# EasyEDA Pro project 效果器12-18.eprj, board PCB1
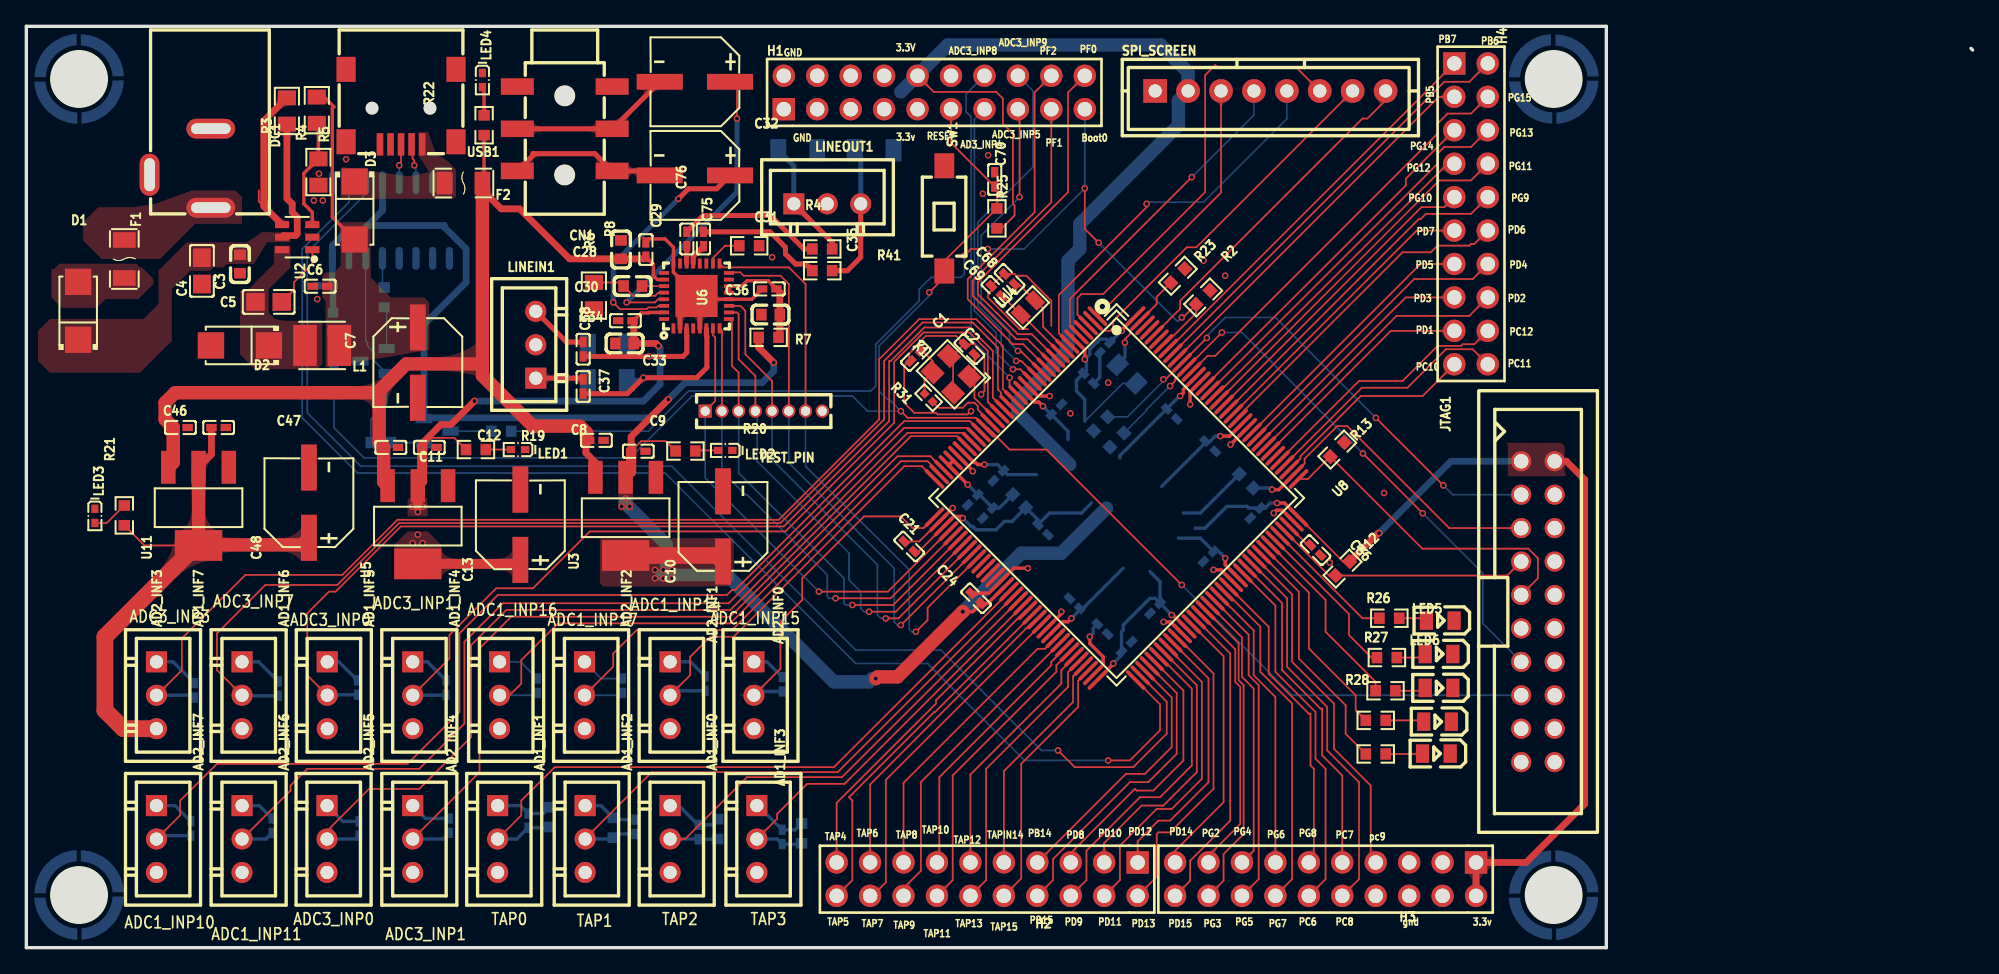
[diagram p8: board, top side]
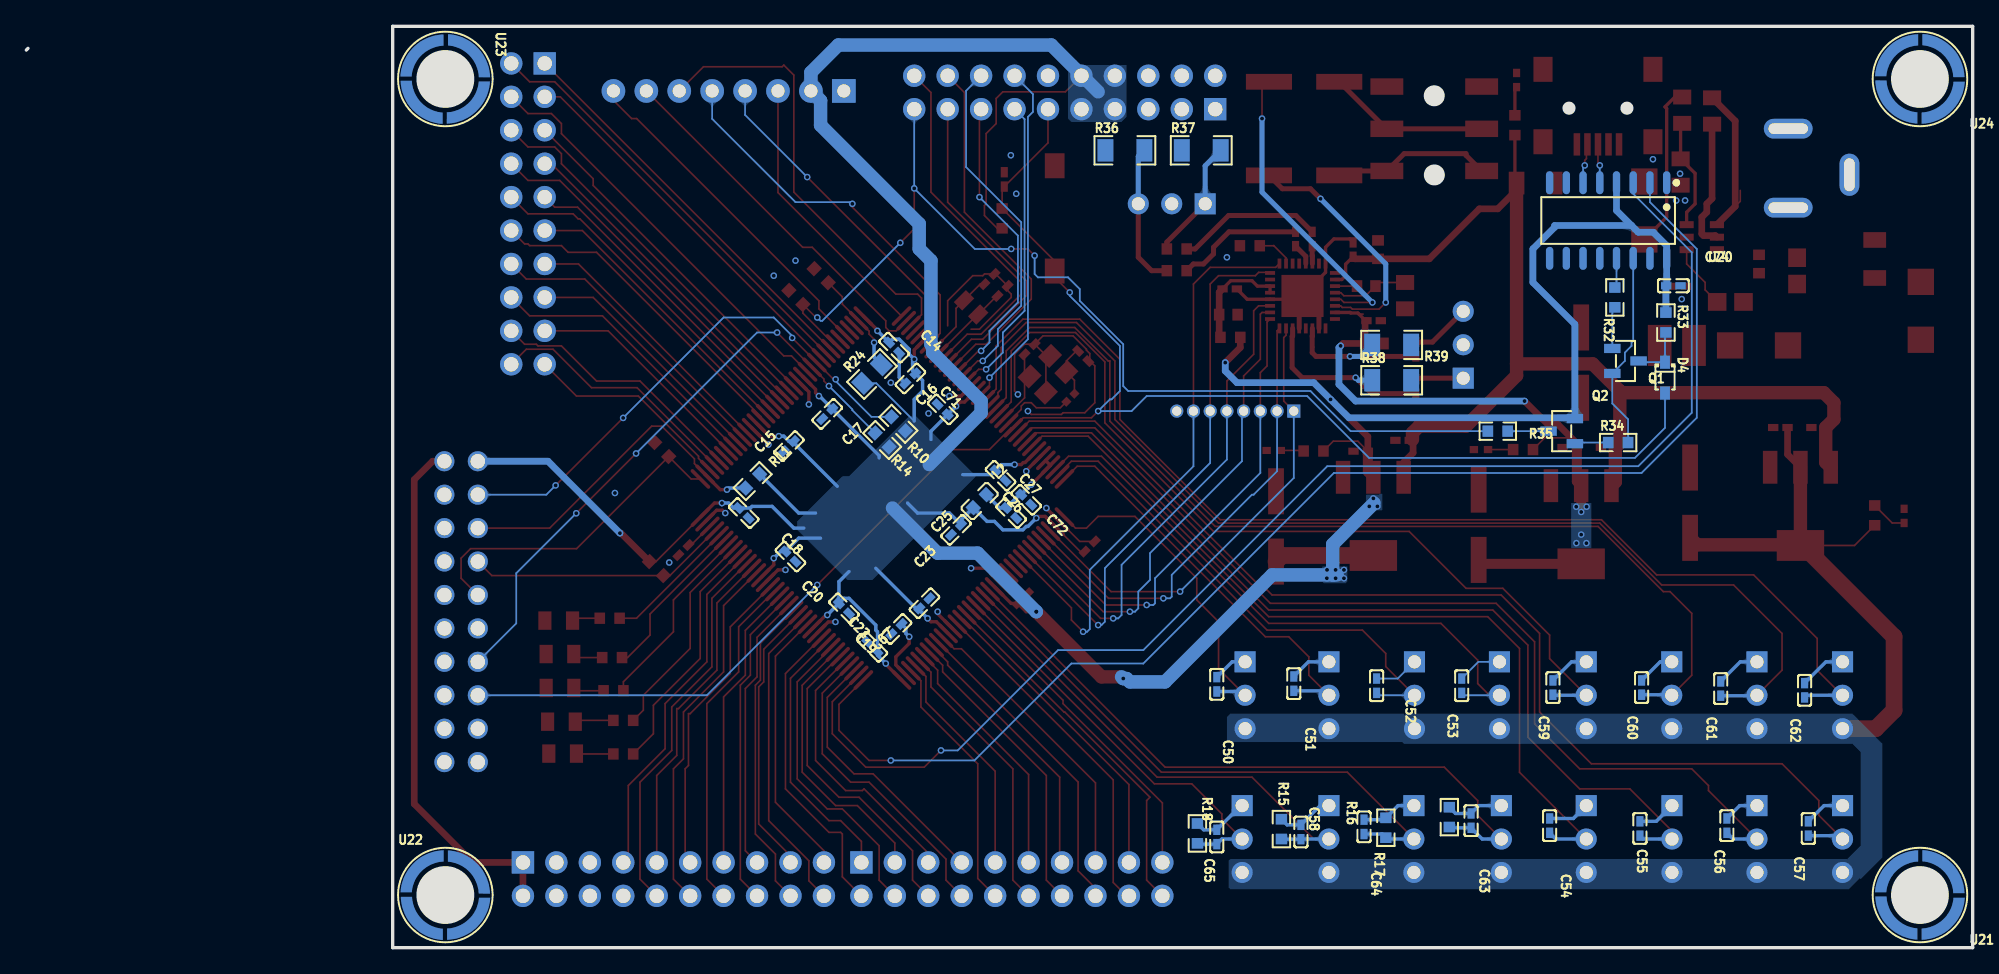
[diagram p9: board, bottom side, seen from below]

Outline 147.83 x 70 mm; copper layers: Top Layer, Bottom Layer. Coordinates in mm from the lower left corner of the outline.
Outline path: 147.83,68.2 147.7,68.33 ; 0,70 120,70 120,0 0,0 0,70
Stack: Top Layer 0.035mm / Dielectric1 1.51mm FR4 er 4.5 / Bottom Layer 0.035mm

## Design rules (mm)
template: JLCPCB Capability(Two Layers Board)
spacing copperThickness1oz (default): track to track 0.102, other pairs 0.152 to 0.3
spacing copperThickness2oz: track to track 0.203, other pairs 0.152 to 0.3
track width copperThickness1oz (default): min 0.127, default 0.254, max 2.54
track width copperThickness2oz: min 0.203, default 0.254, max 2.54
differential pair differentialPair (default): width min 0.127, default 0.254, max 2.54; gap min 0.152, default 0.152
via viaSize (default): diameter min 0.5, default 0.61, max 10; hole min 0.3, default 0.305, max 6.3

## Placement (name value [footprint] x y rotation side)
AD1_INF0  ZX-XH2.54-3PZZ  [CONN-TH_3P-P2.54_2501S-3P]  48.89 8.25 270 top
AD1_INF1  ZX-XH2.54-3PZZ  [CONN-TH_3P-P2.54_2501S-3P]  35.8 8.25 270 top
AD1_INF2  ZX-XH2.54-3PZZ  [CONN-TH_3P-P2.54_2501S-3P]  42.44 8.25 270 top
AD1_INF3  ZX-XH2.54-3PZZ  [CONN-TH_3P-P2.54_2501S-3P]  55.48 8.25 270 top
AD1_INF4  ZX-XH2.54-3PZZ  [CONN-TH_3P-P2.54_2501S-3P]  29.35 19.18 270 top
AD1_INF5  ZX-XH2.54-3PZZ  [CONN-TH_3P-P2.54_2501S-3P]  22.86 19.18 270 top
AD1_INF6  ZX-XH2.54-3PZZ  [CONN-TH_3P-P2.54_2501S-3P]  16.38 19.18 270 top
AD1_INF7  ZX-XH2.54-3PZZ  [CONN-TH_3P-P2.54_2501S-3P]  9.88 19.18 270 top
AD2_INF0  ZX-XH2.54-3PZZ  [CONN-TH_3P-P2.54_2501S-3P]  55.26 19.18 270 top
AD2_INF1  ZX-XH2.54-3PZZ  [CONN-TH_3P-P2.54_2501S-3P]  48.89 19.18 270 top
AD2_INF2  ZX-XH2.54-3PZZ  [CONN-TH_3P-P2.54_2501S-3P]  42.39 19.18 270 top
AD2_INF3  ZX-XH2.54-3PZZ  [CONN-TH_3P-P2.54_2501S-3P]  35.94 19.18 270 top
AD2_INF4  ZX-XH2.54-3PZZ  [CONN-TH_3P-P2.54_2501S-3P]  29.35 8.25 270 top
AD2_INF5  ZX-XH2.54-3PZZ  [CONN-TH_3P-P2.54_2501S-3P]  22.84 8.25 270 top
AD2_INF6  ZX-XH2.54-3PZZ  [CONN-TH_3P-P2.54_2501S-3P]  16.38 8.25 270 top
AD2_INF7  ZX-XH2.54-3PZZ  [CONN-TH_3P-P2.54_2501S-3P]  9.88 8.25 270 top
C1  10pF  [C0402]  67.55 44.95 225 top
C2  10pF  [C0402]  71.63 45.47 135 top
C3  100nF  [C0603]  16.23 51.94 90 top
C4  10uF  [C0805]  13.33 51.42 90 top
C5  10nF  [C0805]  18.41 49.06 0 top
C6  100nF  [C0402]  22.31 50.25 0 top
C7  100uF  [CAP-SMD_BD6.3-L6.6-W6.6-FD]  29.73 44.45 270 top
C8  100nF  [C0402]  43.3 38.55 180 top
C9  100nF  [C0402]  46.48 37.72 180 top
C10  100uF  [CAP-SMD_BD6.3-L6.6-W6.6-FD]  52.91 32 90 top
C11  100nF  [C0402]  27.69 38 180 top
C12  100nF  [C0402]  30.61 38 180 top
C13  100uF  [CAP-SMD_BD6.3-L6.6-W6.6-FD]  37.52 32.13 90 top
C14  100nF  [C0402]  81.91 45.59 45 bottom
C15  100nF  [C0402]  89.92 38.1 135 bottom
C16  100nF  [C0402]  80.68 43.25 135 bottom
C17  100nF  [C0402]  87 40.55 135 bottom
C18  100nF  [C0402]  93.34 33.02 45 bottom
C19  100nF  [C0402]  85.72 25.78 45 bottom
C20  100nF  [C0402]  89.79 29.72 45 bottom
C21  100nF  [C0402]  67.06 30.48 315 top
C22  100nF  [C0402]  83.57 22.86 225 bottom
C23  100nF  [C0402]  79.61 26.16 315 bottom
C24  100nF  [C0402]  72.14 26.54 315 top
C25  100nF  [C0402]  77.22 31.75 135 bottom
C26  100nF  [C0402]  73.03 33.02 45 bottom
C27  100nF  [C0402]  71.88 34.04 45 bottom
C28  10uF  [C0603]  45.16 53.03 270 top
C29  100nF  [C0402]  47.06 53.04 270 top
C30  10uF  [C0603]  46.06 50.26 0 top
C31  100uF  [CAP-SMD_BD6.3-L6.6-W6.6-FD]  50.78 58.67 180 top
C32  100uF  [CAP-SMD_BD6.3-L6.6-W6.6-FD]  50.78 65.79 180 top
C33  10uF  [C0603]  45.44 45.9 0 top
C34  100nF  [C0402]  45.5 47.64 0 top
C35  10uF  [C0603]  56.53 48.1 0 top
C36  100nF  [C0402]  56.43 50.05 0 top
C37  1uF  [C0402]  42.29 42.64 90 top
C38  1uF  [C0402]  42.29 45.47 90 top
C46  100nF  [C0402]  11.7 39.52 180 top
C47  100nF  [C0402]  14.61 39.52 180 top
C48  100uF  [CAP-SMD_BD6.3-L6.6-W6.6-FD]  21.46 33.81 90 top
C50  2.2uF  [C0402]  57.41 20.01 90 bottom
C51  2.2uF  [C0402]  51.56 20.06 90 bottom
C52  2.2uF  [C0402]  45.27 19.9 90 bottom
C53  2.2uF  [C0402]  38.81 19.9 90 bottom
C54  2.2uF  [C0402]  32.13 9.27 90 bottom
C55  2.2uF  [C0402]  25.27 9.06 90 bottom
C56  2.2uF  [C0402]  18.67 9.27 90 bottom
C57  2.2uF  [C0402]  12.48 9.06 90 bottom
C58  2.2uF  [C0402]  51.02 8.79 90 bottom
C59  2.2uF  [C0402]  31.88 19.76 90 bottom
C60  2.2uF  [C0402]  25.15 19.76 90 bottom
C61  2.2uF  [C0402]  19.14 19.69 90 bottom
C62  2.2uF  [C0402]  12.77 19.55 90 bottom
C63  2.2uF  [C0402]  38.1 9.65 90 bottom
C64  2.2uF  [C0402]  46.23 9.18 90 bottom
C65  2.2uF  [C0402]  57.41 8.41 90 bottom
C66  2.2uF  [C0402]  97.92 30.21 135 top
C67  2.2uF  [C0402]  81.74 24.21 315 bottom
C68  20pF  [C0402]  74.68 50.8 315 top
C69  20pF  [C0402]  73.68 49.9 315 top
C70  100nF  [C0402]  73.55 58.37 270 top
C71  100nF  [C0402]  78.23 40.89 225 bottom
C72  100nF  [C0402]  73.84 35.86 45 bottom
C74  100nF  [C0402]  22.73 50.29 0 bottom
C75  1uF  [C0402]  51.43 53.84 270 top
C76  1uF  [C0402]  50.17 53.84 270 top
CN1  PJ-313D  [AUDIO-SMD_PJ-313D-2]  40.89 62.22 0 top
D1  SS24  [SMA_L4.3-W2.6-LS5.2-RD]  3.94 48.39 90 top
D2  SS24  [SMA_L4.3-W2.6-LS5.2-RD]  16.22 45.76 180 top
D3  SS24  [SMA_L4.3-W2.6-LS5.2-RD]  24.94 56.01 270 top
D4  1N4148WS  [SOD-323_L1.8-W1.3-LS2.5-RD]  23.37 43.31 270 bottom
DC1  DC-005-A250  [DC-IN-TH_DC-005-A250]  11.68 59.22 270 top
F1  BSMD1206-100-16V  [F1206]  7.44 52.32 270 top
F2  BSMD1206-100-16V  [F1206]  33.2 58.09 180 top
H1  PZ254V-12-20P  [HDR-TH_20P-P2.54-V-M-R2-C10-S2.54]  68.96 64.97 0 top
H2  PZ254V-12-20P  [HDR-TH_20P-P2.54-V-M-R2-C10-S2.54]  72.97 5.21 180 top
H3  PZ254V-12-20P  [HDR-TH_20P-P2.54-V-M-R2-C10-S2.54]  98.68 5.21 180 top
H4  PZ254V-12-20P  [HDR-TH_20P-P2.54-V-M-R2-C10-S2.54]  109.73 55.75 270 top
JTAG1  BH254V-20P  [CONN-TH_20P-P2.54_0702462001]  114.81 25.53 270 top
L1  4.7uH  [IND-SMD_L3.5-W3.0]  22.47 45.76 180 top
L2  PZ1608D121-2R0TF  [L0603]  75.41 33.93 135 bottom
LED1  TJ-S1005SW4TGLC9Y-A5  [LED0402-RD_YELLOW]  37.35 37.84 180 top
LED2  TJ-S1005SW4TGLC9Y-A5  [LED0402-RD_YELLOW]  53.09 37.78 180 top
LED3  TJ-S1005SW4TGLC9Y-A5  [LED0402-RD_YELLOW]  5.21 32.8 270 top
LED4  TJ-S1005SW4TGLC9Y-A5  [LED0402-RD_YELLOW]  34.64 65.92 270 top
LED5  NCD0805R1  [LED0805-R-RD]  107.39 24.85 180 top
LED6  NCD0805R1  [LED0805-R-RD]  107.3 22.31 180 top
LED7  NCD0805R1  [LED0805-R-RD]  107.29 19.73 180 top
LED8  NCD0805R1  [LED0805-R-RD]  107.18 17.17 180 top
LED9  NCD0805R1  [LED0805-R-RD]  107.09 14.75 180 top
LINEIN1  ZX-XH2.54-3PZZ  [CONN-TH_3P-P2.54_2501S-3P]  38.69 45.81 90 top
LINEOUT1  ZX-XH2.54-3PZZ  [CONN-TH_3P-P2.54_2501S-3P]  60.83 56.52 0 top
Q1  S8050  [SOT-23-3_L2.9-W1.3-P1.90-LS2.4-BR]  26.37 44.58 0 bottom
Q2  S8550  [SOT-23-3_L2.9-W1.3-P1.90-LS2.4-BR]  31.21 39.24 180 bottom
R2  10kΩ  [R0603]  89.38 49.4 225 top
R3  12.1kΩ  [R0805]  19.79 63.57 90 top
R4  68kΩ  [R0805]  22.06 63.63 270 top
R5  12.1kΩ  [R0805]  22.18 58.93 90 top
R6  0Ω  [R0805]  43.11 49.54 270 top
R7  10Ω  [R0603]  56.38 46.37 0 top
R8  10kΩ  [R0603]  54.9 53.33 180 top
R10  10kΩ  [R0603]  81.59 39.8 225 bottom
R11  10kΩ  [R0603]  92.66 35.45 135 bottom
R12  10kΩ  [R0603]  99.97 28.8 45 top
R13  10kΩ  [R0603]  99.57 37.85 45 top
R14  10kΩ  [R0603]  82.83 38.57 225 bottom
R15  4.7kΩ  [R0603]  52.5 9.01 270 bottom
R16  4.7kΩ  [R0603]  39.75 9.92 270 bottom
R17  4.7kΩ  [R0603]  44.57 9.11 270 bottom
R18  4.7kΩ  [R0603]  58.88 8.68 270 bottom
R19  4.7kΩ  [R0603]  34.15 37.84 180 top
R20  4.7kΩ  [R0603]  50.06 37.73 180 top
R21  4.7kΩ  [R0603]  7.44 32.84 270 top
R22  4.7kΩ  [R0603]  34.77 62.49 270 top
R23  10kΩ  [R0603]  87.46 51.05 45 top
R24  0Ω  [R0805]  83.59 43.58 135 bottom
R25  10kΩ  [R0603]  73.71 55.41 270 top
R26  1kΩ  [R0603]  103.52 25.03 0 top
R27  1kΩ  [R0603]  103.34 22.04 0 top
R28  1kΩ  [R0603]  103.23 19.52 0 top
R29  1kΩ  [R0603]  102.49 17.27 0 top
R30  1kΩ  [R0603]  102.49 14.72 0 top
R31  30Ω  [R0402]  68.53 41.78 315 top
R32  1kΩ  [R0603]  27.18 49.4 90 bottom
R33  10kΩ  [R0603]  23.3 47.5 270 bottom
R34  1kΩ  [R0603]  26.92 38.38 180 bottom
R35  1kΩ  [R0603]  36.07 39.24 0 bottom
R36  1MΩ  [R1206]  64.39 60.58 180 bottom
R37  1MΩ  [R1206]  58.59 60.58 180 bottom
R38  1MΩ  [R1206]  44.13 43.11 180 bottom
R39  1MΩ  [R1206]  44.13 45.8 0 bottom
R41  100Ω  [R0603]  60.45 51.44 180 top
R42  100Ω  [R0603]  60.45 53.09 0 top
SPI_SCREEN  XH-8A  [CONN-TH_8P-P2.50_HCTL_XH-8A_C2908606]  94.49 65.09 0 top
SW1  TS-1101-C-W  [SW-SMD_L6.0-W3.3-LS8.0]  69.72 55.41 270 top
TEST_PIN  PZ127V-11-08-H25  [HDR-TH_8P-P1.27_PZ127V-11-08-H25]  56.01 40.77 0 top
U2  TPMP2359DJ  [SOT-23-6_L2.9-W1.6-P0.95-LS2.8-BL]  20.57 53.98 90 top
U3  LM1117S-3.3  [SOT-223-3_L6.5-W3.4-P2.30-LS7.0-BR]  45.52 32.77 90 top
U5  LM1117S-3.3  [SOT-223-3_L6.5-W3.4-P2.30-LS7.0-BR]  29.73 32.13 90 top
U6  WM8978CGEFL/RV  [WQFN-32_L5.0-W5.0-P0.50-TL-EP]  50.9 49.51 90 top
U8  STM32H743ZIT6  [LQFP-144_L20.0-W20.0-P0.50-LS22.0-BL]  82.8 34.16 225 top
U11  LM1117S-3.3  [SOT-223-3_L6.5-W3.4-P2.30-LS7.0-BR]  13.08 33.53 90 top
U14  32.768kHz  [CRYSTAL-SMD_L2.0-W1.2]  76.07 48.65 225 top
U20  CH340C  [SOP-16_L10.0-W3.9-P1.27-LS6.0-BL]  27.69 55.25 0 bottom
U21  SMTSO3050CTJ  [SMD_SMTSO3060CTJ]  4.01 4 0 bottom
U22  SMTSO3050CTJ  [SMD_SMTSO3060CTJ]  116 4 180 bottom
U23  SMTSO3050CTJ  [SMD_SMTSO3060CTJ]  116 66 270 bottom
U24  SMTSO3050CTJ  [SMD_SMTSO3060CTJ]  4.01 66 0 bottom
USB1  UX-144S-ACP5  [MINI-USB-SMD_UX-144S-ACP5]  28.46 63.88 180 top
X1  24MHz  [OSC-SMD_4P-L3.2-W2.5-BL]  70.23 43.56 135 top

## Footprints (pads in the part's own frame, mm; a bottom-side part is the same pattern mirrored in y, then rotated)
AUDIO-SMD_PJ-313D-2
  rect 2.5x1.25 smd: 1(-3.6,3.205) 1(3.6,3.205) 2(-3.6,-0.005) 2(3.6,-0.005) 3(-3.6,-3.205) 3(3.6,-3.205)
C0402
  rect 0.79x0.54 smd: 1(-0.545,0) 2(0.545,0)
C0603
  rect 0.8x0.9 smd: 1(-0.7,0) 2(0.7,0)
C0805
  rect 1.41x1.35 smd: 1(-1,0) 2(1,0)
CAP-SMD_BD6.3-L6.6-W6.6-FD
  rect 3.5x1.2 smd: 1(-2.67,0) 2(2.67,0)
CONN-TH_3P-P2.54_2501S-3P
  rect 1.6x1.6 hole 1: 1(-2.54,0)
  round 1.6 hole 1: 2(0,0) 3(2.54,0)
CONN-TH_8P-P2.50_HCTL_XH-8A_C2908606
  rect 1.8x1.8 hole 1: 1(-8.75,0.001)
  round 1.8 hole 1: 2(-6.25,0.001) 3(-3.749,0.001) 4(-1.25,0) 5(1.25,0) 6(3.75,-0.001) 7(6.25,-0.001) 8(8.75,-0.001)
CONN-TH_20P-P2.54_0702462001
  round 1.524 hole 1.1: 1(-11.43,-1.27) 2(-11.43,1.27) 3(-8.89,-1.27) 4(-8.89,1.27) 5(-6.35,-1.27) 6(-6.35,1.27) 7(-3.81,-1.27) 8(-3.81,1.27) 9(-1.27,-1.27) 10(-1.27,1.27) 11(1.27,-1.27) 12(1.27,1.27) 13(3.81,-1.27) 14(3.81,1.27) 15(6.35,-1.27) 16(6.35,1.27) 17(8.89,-1.27) 18(8.89,1.27) 19(11.43,-1.27) 20(11.43,1.27)
CRYSTAL-SMD_L2.0-W1.2
  rect 0.9x1.3 smd: 1(-0.762,0) 2(0.762,0)
DC-IN-TH_DC-005-A250
  oval 1.5x3.7 hole 0.8x3: 1(3,2.325) 2(-3,2.325)
  oval 3.2x1.5 hole 2.5x0.8: 3(0.5,-2.325)
F1206
  rect 1.19x1.728 smd: 1(-1.445,0) 2(1.445,0)
HDR-TH_8P-P1.27_PZ127V-11-08-H25
  rect 1x1 hole 0.7: 1(-4.445,0)
  round 1 hole 0.7: 2(-3.175,0) 3(-1.905,0) 4(-0.635,0) 5(0.635,0) 6(1.905,0) 7(3.175,0) 8(4.445,0)
HDR-TH_20P-P2.54-V-M-R2-C10-S2.54
  rect 1.7x1.7 hole 1.1: 1(-11.43,-1.27)
  round 1.7 hole 1.1: 2(-11.43,1.27) 3(-8.89,-1.27) 4(-8.89,1.27) 5(-6.35,-1.27) 6(-6.35,1.27) 7(-3.81,-1.27) 8(-3.81,1.27) 9(-1.27,-1.27) 10(-1.27,1.27) 11(1.27,-1.27) 12(1.27,1.27) 13(3.81,-1.27) 14(3.81,1.27) 15(6.35,-1.27) 16(6.35,1.27) 17(8.89,-1.27) 18(8.89,1.27) 19(11.43,-1.27) 20(11.43,1.27)
IND-SMD_L3.5-W3.0
  rect 1.8x3.12 smd: 1(1.303,0) 2(-1.303,0)
L0603
  rect 0.8x0.864 smd: 1(-0.7,0) 2(0.7,0)
LED0402-RD_YELLOW
  rect 0.636x0.54 smd: 1(-0.538,0) 2(0.538,0)
LED0805-R-RD
  rect 1x1.399 smd: 1(1.05,0) 2(-1.05,0)
LQFP-144_L20.0-W20.0-P0.50-LS22.0-BL
  oval 0.28x2 smd: 1(-8.75,-10.8) 2(-8.25,-10.8) 3(-7.75,-10.8) 4(-7.25,-10.8) 5(-6.75,-10.8) 6(-6.25,-10.8) 7(-5.75,-10.8) 8(-5.25,-10.8) 9(-4.75,-10.8) 10(-4.25,-10.8) 11(-3.75,-10.8) 12(-3.25,-10.8) 13(-2.75,-10.8) 14(-2.25,-10.8) 15(-1.75,-10.8) 16(-1.25,-10.8) 17(-0.75,-10.8) 18(-0.25,-10.8) 19(0.25,-10.8) 20(0.75,-10.8) 21(1.25,-10.8) 22(1.75,-10.8) 23(2.25,-10.8) 24(2.75,-10.8) 25(3.25,-10.8) 26(3.75,-10.8) 27(4.25,-10.8) 28(4.75,-10.8) 29(5.25,-10.8) 30(5.75,-10.8) 31(6.25,-10.8) 32(6.75,-10.8) 33(7.25,-10.8) 34(7.75,-10.8) 35(8.25,-10.8) 36(8.75,-10.8) 73(8.75,10.8) 74(8.25,10.8) 75(7.75,10.8) 76(7.25,10.8) 77(6.75,10.8) 78(6.25,10.8) 79(5.75,10.8) 80(5.25,10.8) 81(4.75,10.8) 82(4.25,10.8) 83(3.75,10.8) 84(3.25,10.8) 85(2.75,10.8) 86(2.25,10.8) 87(1.75,10.8) 88(1.25,10.8) 89(0.75,10.8) 90(0.25,10.8) 91(-0.25,10.8) 92(-0.75,10.8) 93(-1.25,10.8) 94(-1.75,10.8) 95(-2.25,10.8) 96(-2.75,10.8) 97(-3.25,10.8) 98(-3.75,10.8) 99(-4.25,10.8) 100(-4.75,10.8) 101(-5.25,10.8) 102(-5.75,10.8) 103(-6.25,10.8) 104(-6.75,10.8) 105(-7.25,10.8) 106(-7.75,10.8) 107(-8.25,10.8) 108(-8.75,10.8)
  oval 2x0.28 smd: 37(10.8,-8.75) 38(10.8,-8.25) 39(10.8,-7.75) 40(10.8,-7.25) 41(10.8,-6.75) 42(10.8,-6.25) 43(10.8,-5.75) 44(10.8,-5.25) 45(10.8,-4.75) 46(10.8,-4.25) 47(10.8,-3.75) 48(10.8,-3.25) 49(10.8,-2.75) 50(10.8,-2.25) 51(10.8,-1.75) 52(10.8,-1.25) 53(10.8,-0.75) 54(10.8,-0.25) 55(10.8,0.25) 56(10.8,0.75) 57(10.8,1.25) 58(10.8,1.75) 59(10.8,2.25) 60(10.8,2.75) 61(10.8,3.25) 62(10.8,3.75) 63(10.8,4.25) 64(10.8,4.75) 65(10.8,5.25) 66(10.8,5.75) 67(10.8,6.25) 68(10.8,6.75) 69(10.8,7.25) 70(10.8,7.75) 71(10.8,8.25) 72(10.8,8.75) 109(-10.8,8.75) 110(-10.8,8.25) 111(-10.8,7.75) 112(-10.8,7.25) 113(-10.8,6.75) 114(-10.8,6.25) 115(-10.8,5.75) 116(-10.8,5.25) 117(-10.8,4.75) 118(-10.8,4.25) 119(-10.8,3.75) 120(-10.8,3.25) 121(-10.8,2.75) 122(-10.8,2.25) 123(-10.8,1.75) 124(-10.8,1.25) 125(-10.8,0.75) 126(-10.8,0.25) 127(-10.8,-0.25) 128(-10.8,-0.75) 129(-10.8,-1.25) 130(-10.8,-1.75) 131(-10.8,-2.25) 132(-10.8,-2.75) 133(-10.8,-3.25) 134(-10.8,-3.75) 135(-10.8,-4.25) 136(-10.8,-4.75) 137(-10.8,-5.25) 138(-10.8,-5.75) 139(-10.8,-6.25) 140(-10.8,-6.75) 141(-10.8,-7.25) 142(-10.8,-7.75) 143(-10.8,-8.25) 144(-10.8,-8.75)
MINI-USB-SMD_UX-144S-ACP5
  rect 0.5x1.7 smd: 1(-1.6,2.85) 2(-0.8,2.85) 3(0,2.85) 4(0.8,2.85) 5(1.6,2.85)
  rect 1.45x1.9 smd: 6(-4.175,2.65) 7(-4.175,-2.85) 8(4.175,-2.85) 9(4.175,2.65)
OSC-SMD_4P-L3.2-W2.5-BL
  rect 1.4x1.2 smd: 1(-1.1,-0.875) 2(1.1,-0.875) 3(1.1,0.875) 4(-1.1,0.875)
R0402
  rect 0.566x0.54 smd: 1(-0.433,0) 2(0.433,0)
R0603
  rect 0.806x0.864 smd: 1(-0.753,0) 2(0.753,0)
R0805
  rect 1.133x1.377 smd: 1(-1,0) 2(1,0)
R1206
  rect 1.208x1.701 smd: 1(-1.479,0) 2(1.479,0)
SMA_L4.3-W2.6-LS5.2-RD
  rect 2x2 smd: 1(-2.2,0) 2(2.2,0)
SMD_SMTSO3060CTJ
  custom 3.197x3.278 smd: 1(1.79,2.34)
  custom 3.279x3.197 smd: 2(1.768,-2.386) 4(-1.769,2.386)
  custom 3.197x3.279 smd: 3(-1.79,-2.369)
SOD-323_L1.8-W1.3-LS2.5-RD
  rect 1x0.75 smd: 1(-1.173,0) 2(1.173,0)
SOP-16_L10.0-W3.9-P1.27-LS6.0-BL
  oval 0.56x1.745 smd: 1(-4.445,-2.873) 2(-3.175,-2.873) 3(-1.905,-2.873) 4(-0.635,-2.873) 5(0.635,-2.873) 6(1.905,-2.873) 7(3.175,-2.873) 8(4.445,-2.873) 9(4.445,2.873) 10(3.175,2.873) 11(1.905,2.873) 12(0.635,2.873) 13(-0.635,2.873) 14(-1.905,2.873) 15(-3.175,2.873) 16(-4.445,2.873)
SOT-23-3_L2.9-W1.3-P1.90-LS2.4-BR
  rect 1.25x0.7 smd: 1(1,-0.95) 2(1,0.95) 3(-1,0)
SOT-23-6_L2.9-W1.6-P0.95-LS2.8-BL
  rect 0.532x1.072 smd: 1(-0.95,-1.149) 2(0,-1.149) 3(0.95,-1.149) 4(0.95,1.149) 5(0,1.149) 6(-0.95,1.149)
SOT-223-3_L6.5-W3.4-P2.30-LS7.0-BR
  rect 2.5x1.1 smd: 1(2.97,-2.3) 2(2.97,0) 3(2.97,2.3)
  rect 2.34x3.6 smd: 4(-2.97,0)
SW-SMD_L6.0-W3.3-LS8.0
  rect 1.9x1.5 smd: 1(-4,0) 2(4,0)
WQFN-32_L5.0-W5.0-P0.50-TL-EP
  rect 0.762x0.287 smd: 1(-2.464,1.75) 2(-2.464,1.25) 3(-2.464,0.75) 4(-2.464,0.25) 5(-2.464,-0.25) 6(-2.464,-0.75) 7(-2.464,-1.25) 8(-2.464,-1.75) 17(2.464,-1.75) 18(2.464,-1.25) 19(2.464,-0.75) 20(2.464,-0.25) 21(2.464,0.25) 22(2.464,0.75) 23(2.464,1.25) 24(2.464,1.75)
  rect 0.287x0.762 smd: 9(-1.75,-2.464) 10(-1.25,-2.464) 11(-0.75,-2.464) 12(-0.25,-2.464) 13(0.25,-2.464) 14(0.75,-2.464) 15(1.25,-2.464) 16(1.75,-2.464) 25(1.75,2.464) 26(1.25,2.464) 27(0.75,2.464) 28(0.25,2.464) 29(-0.25,2.464) 30(-0.75,2.464) 31(-1.25,2.464) 32(-1.75,2.464)
  rect 3.2x3.2 smd: 33(0,0)

## Nets
As in the schematic.

Pads without a net: DC1 3; H1 5 6 12; H3 3 4 8; JTAG1 11 17 19; TEST_PIN 8; U6 1 4 15 19 20 23 25 32; U20 7 8 9 10 11 12 15; U21 2 3 4; U22 2 3 4; U23 2 3 4; U24 2 3 4

## Via types
v1: diameter 0.5, hole 0.3, Top Layer to Bottom Layer, 103 vias
v2: diameter 1.016, hole 0.3, Top Layer to Bottom Layer, 2 vias

## Routing (per net, layer and track width the routed paths; a pad name or vN(x,y) marks a point on that pad's centre or on a via; arc(x,y) is an arc through that point)
3.3V: length 385.2
  Top Layer w0.127: H1.10 68.91,65.02 73.66,65.02 74.17,64.52 74.17,62.61 74.93,61.85 74.93,56.52 75.06,56.39 75.06,55.63 74.09,54.65 R25.2 ; R12.2 100.01,29.34 U8.108 ; R20.2 48.56,38.48 46.7,38.48 C9.2 ; C21.2 67.78,30.09 U8.39
  Top Layer w0.254: U8.6 80.39,45.41 v1(80.39,44.7) ; 77.82,23.87 78.71,24.77 79.12,24.77 v1(79.38,25.02) ; 92.03,28.12 91.06,29.09 v1(91.06,29.59) ; U8.52 73.03,26.16 C24.2 71.89,25.53 v2(71.12,25.53) ; v1(90.68,38.86) 91.39,38.86 U8.121 ; U8.30 71.98,36.86 72.11,36.86 72.26,36.7 v1(72.77,36.7) ; 84.25,47.99 83.19,46.92 v1(83.19,46.86) ; U8.108 95.56,33.78 v1(95,33.78) ; U8.39 70.45,32.77 70.99,32.77 v1(71.12,32.64) ; v1(87,25.27) 87.1,25.27 88.14,24.23 ; v1(77.22,41.14) 76.9,41.45 76.57,41.45 U8.17 ; U8.72 82.55,21.53 v1(82.55,21.59) ; 88.85,43.39 88.85,43.38 87.88,42.42 87.88,42.16 v1(87.63,41.91)
  Top Layer w0.508: C9.2 45.94,38.83 v1(48.77,41.66) ; v1(102.74,31.5) 102.66,31.5 R12.2 ; H3.2 H3.1 113.92,6.48 118.36,10.92 118.36,35.56 116.97,36.96 JTAG1.2 ; v1(56.77,44.45) 55.63,45.59 R7.1
  Top Layer w0.762: C9.2 45.94,36.15 U3.2
  Top Layer w1.016: 64.64,20.57 66.17,20.57 v2(71.12,25.53)
  Top Layer w1.27: C10.1 52.45,29.8 U3.4
  Bottom Layer w0.127: 80.39,40 83.26,42.88 84.3,42.88
  Bottom Layer w0.254: C19.2 85.73,26.54 85.34,26.54 83.31,24.51 83.31,24.13 83.18,24 C22.2 83.18,22.22 v1(82.55,21.59) ; C19.2 86.11,27.81 85.34,28.58 ; C19.2 86.11,26.16 v1(87,25.27) ; v1(72.77,36.7) 73.77,36.7 C72.2 74.53,35.94 76.71,35.94 ; 87.5,31.11 89.16,31.11 C20.2 90.55,30.1 v1(91.06,29.59) ; 86.23,35.05 89.53,38.35 C15.2 89.92,38.49 90.3,38.86 v1(90.68,38.86) ; 95,33.66 v1(95,33.78) 94.49,33.78 94.11,33.41 C18.2 92.83,33.41 92.71,33.53 91.19,33.53 89.53,31.88 88.77,31.88 ; R11.2 89.16,33.02 87.88,33.02 ; v1(87.63,41.91) 87.58,41.91 C17.2 83.06,37.39 83.06,37.21 ; 83.31,28.83 80.26,25.78 80,25.78 80,25.64 v1(79.38,25.02) ; v1(83.19,46.86) C14.2 82.05,46.23 81.53,46.23 80.77,45.47 80.77,45.08 v1(80.39,44.7) 80.52,44.7 80.52,43.86 C16.2 79.76,43.09 79.76,42.29 80.39,41.66 80.39,40 ; 79.12,38.61 79.12,39.23 C71.2 v1(77.22,41.14) 77.22,41.15 ; v1(71.12,32.64) 71.75,32 71.88,32 72.14,31.75 73.66,31.75 74.29,32.39 74.86,32.39 L2.1 76.83,32.51 C25.2 77.72,33.02 80.14,33.02 80.9,33.78
  Bottom Layer w0.508: 23.3,50.32 R33.1 ; 23.3,50.32 23.24,50.38 23.24,53.34 24.26,54.36 25.4,54.36 25.91,54.86 ; 23.3,50.32 23.33,50.29 ; 25.91,54.86 31.75,54.86 31.75,54.74 33.4,53.09 33.4,50.55 30.21,47.36 Q2.2 30.28,40.26 47.37,40.26 v1(48.77,41.66) 50.04,42.93 55.88,42.93 56.77,43.81 v1(56.77,44.45) ; 25.91,54.86 27.05,56.01 U20.4 ; v1(102.74,31.5) 108.2,36.96 JTAG1.1
  Bottom Layer w1.016: 48.61,28.32 48.61,30.64 45.47,33.78 ; 48.61,28.32 48.26,28.32 ; 48.61,28.32 53.21,28.32 61.34,20.19 64.01,20.19 64.26,20.45 v2(64.52,20.45) 64.64,20.57 ; 66.42,65.02 69.98,68.58 86.16,68.58 88.24,66.5 SPI_SCREEN.2 87.5,64.36 87.5,62.48 80.01,54.99 80.01,53.09 79.12,52.2 79.12,45.85 78.99,45.72 78.99,45.21 75.31,41.53 75.31,40.64 79.25,36.7 ; v2(71.12,25.53) 75.56,29.97 78.61,29.97 82.04,33.4